# EAGLE board Resistor_Resistor (EAGLE 8.3.0), part 3 of 32
## Placement (x,y rotation side) (continued)
R2623  10K  [0201]  41.2,14.68 0 top
R2624  10K  [0201]  41.2,15.29 0 top
R2625  10K  [0201]  41.2,15.9 0 top
R2626  10K  [0201]  41.2,16.51 0 top
R2627  10K  [0201]  41.2,17.12 0 top
R2628  10K  [0201]  41.2,17.73 0 top
R2629  10K  [0201]  41.2,18.34 0 top
R2630  10K  [0201]  41.2,18.95 0 top
R2631  10K  [0201]  41.2,19.56 0 top
R2632  10K  [0201]  41.2,20.17 0 top
R2633  10K  [0201]  41.2,20.78 0 top
R2634  10K  [0201]  41.2,21.39 0 top
R2635  10K  [0201]  41.2,22 0 top
R2636  10K  [0201]  41.2,22.61 0 top
R2637  10K  [0201]  41.2,23.22 0 top
R2638  10K  [0201]  41.2,23.83 0 top
R2639  10K  [0201]  41.2,24.43 0 top
R2640  10K  [0201]  41.2,25.04 0 top
R2641  10K  [0201]  41.2,25.65 0 top
R2642  10K  [0201]  41.2,26.26 0 top
R2643  10K  [0201]  41.2,26.87 0 top
R2644  10K  [0201]  41.2,27.48 0 top
R2645  10K  [0201]  41.2,28.09 0 top
R2646  10K  [0201]  41.2,28.7 0 top
R2647  10K  [0201]  41.2,29.31 0 top
R2648  10K  [0201]  41.2,29.92 0 top
R2649  10K  [0201]  41.2,30.53 0 top
R2650  10K  [0201]  41.2,31.14 0 top
R2651  10K  [0201]  41.2,31.75 0 top
R2652  10K  [0201]  41.2,32.36 0 top
R2653  10K  [0201]  41.2,32.97 0 top
R2654  10K  [0201]  41.2,33.58 0 top
R2655  10K  [0201]  41.2,34.19 0 top
R2656  10K  [0201]  41.2,34.8 0 top
R2657  10K  [0201]  41.2,35.41 0 top
R2658  10K  [0201]  41.2,36.02 0 top
R2659  10K  [0201]  41.2,36.63 0 top
R2660  10K  [0201]  41.2,37.24 0 top
R2661  10K  [0201]  41.2,37.85 0 top
R2662  10K  [0201]  41.2,38.46 0 top
R2663  10K  [0201]  41.2,39.07 0 top
R2664  10K  [0201]  41.2,39.67 0 top
R2665  10K  [0201]  41.2,40.28 0 top
R2666  10K  [0201]  41.2,40.89 0 top
R2667  10K  [0201]  41.2,41.5 0 top
R2668  10K  [0201]  41.2,42.11 0 top
R2669  10K  [0201]  41.2,42.72 0 top
R2670  10K  [0201]  41.2,43.33 0 top
R2671  10K  [0201]  41.2,43.94 0 top
R2672  10K  [0201]  41.2,44.55 0 top
R2673  10K  [0201]  41.2,45.16 0 top
R2674  10K  [0201]  41.2,45.77 0 top
R2675  10K  [0201]  41.2,46.38 0 top
R2676  10K  [0201]  41.2,46.99 0 top
R2677  10K  [0201]  41.2,47.6 0 top
R2678  10K  [0201]  41.2,48.21 0 top
R2679  10K  [0201]  41.2,48.82 0 top
R2680  10K  [0201]  41.2,49.43 0 top
R2681  10K  [0201]  41.2,50.04 0 top
R2682  10K  [0201]  41.2,50.65 0 top
R2683  10K  [0201]  41.2,51.26 0 top
R2684  10K  [0201]  41.2,51.87 0 top
R2685  10K  [0201]  41.2,52.48 0 top
R2686  10K  [0201]  41.2,53.09 0 top
R2687  10K  [0201]  41.2,53.7 0 top
R2688  10K  [0201]  41.2,54.31 0 top
R2689  10K  [0201]  41.2,54.91 0 top
R2690  10K  [0201]  41.2,55.52 0 top
R2691  10K  [0201]  41.2,56.13 0 top
R2692  10K  [0201]  41.2,56.74 0 top
R2693  10K  [0201]  41.2,57.35 0 top
R2694  10K  [0201]  41.2,57.96 0 top
R2695  10K  [0201]  41.2,58.57 0 top
R2696  10K  [0201]  41.2,59.18 0 top
R2697  10K  [0201]  41.2,59.79 0 top
R2698  10K  [0201]  41.2,60.4 0 top
R2699  10K  [0201]  41.2,61.01 0 top
R2700  10K  [0201]  41.2,61.62 0 top
R2701  10K  [0201]  41.2,62.23 0 top
R2702  10K  [0201]  41.2,62.84 0 top
R2703  10K  [0201]  41.2,63.45 0 top
R2704  10K  [0201]  41.2,64.06 0 top
R2705  10K  [0201]  41.2,64.67 0 top
R2706  10K  [0201]  41.2,65.28 0 top
R2707  10K  [0201]  41.2,65.89 0 top
R2708  10K  [0201]  41.2,66.5 0 top
R2709  10K  [0201]  41.2,67.11 0 top
R2710  10K  [0201]  41.2,67.72 0 top
R2711  10K  [0201]  41.2,68.33 0 top
R2712  10K  [0201]  41.2,68.94 0 top
R2713  10K  [0201]  41.2,69.55 0 top
R2714  10K  [0201]  41.2,70.15 0 top
R2715  10K  [0201]  41.2,70.76 0 top
R2716  10K  [0201]  41.2,71.37 0 top
R2717  10K  [0201]  41.2,71.98 0 top
R2718  10K  [0201]  41.2,72.59 0 top
R2719  10K  [0201]  41.2,73.2 0 top
R2720  10K  [0201]  41.2,73.81 0 top
R2721  10K  [0201]  41.2,74.42 0 top
R2722  10K  [0201]  41.2,75.03 0 top
R2723  10K  [0201]  41.2,75.64 0 top
R2724  10K  [0201]  41.2,76.25 0 top
R2725  10K  [0201]  41.2,76.86 0 top
R2726  10K  [0201]  41.2,77.47 0 top
R2727  10K  [0201]  41.2,78.08 0 top
R2728  10K  [0201]  41.2,78.69 0 top
R2729  10K  [0201]  41.2,79.3 0 top
R2730  10K  [0201]  41.2,79.91 0 top
R2731  10K  [0201]  41.2,80.52 0 top
R2732  10K  [0201]  41.2,81.13 0 top
R2733  10K  [0201]  41.2,81.74 0 top
R2734  10K  [0201]  41.2,82.35 0 top
R2735  10K  [0201]  41.2,82.96 0 top
R2736  10K  [0201]  41.2,83.57 0 top
R2737  10K  [0201]  41.2,84.18 0 top
R2738  10K  [0201]  41.2,84.79 0 top
R2739  10K  [0201]  41.2,85.39 0 top
R2740  10K  [0201]  41.2,86 0 top
R2741  10K  [0201]  41.2,86.61 0 top
R2742  10K  [0201]  41.2,87.22 0 top
R2743  10K  [0201]  41.2,87.83 0 top
R2744  10K  [0201]  41.2,88.44 0 top
R2745  10K  [0201]  41.2,89.05 0 top
R2746  10K  [0201]  41.2,89.66 0 top
R2747  10K  [0201]  41.2,90.27 0 top
R2748  10K  [0201]  41.2,90.88 0 top
R2749  10K  [0201]  41.2,91.49 0 top
R2750  10K  [0201]  41.2,92.1 0 top
R2751  10K  [0201]  41.2,92.71 0 top
R2752  10K  [0201]  41.2,93.32 0 top
R2753  10K  [0201]  41.2,93.93 0 top
R2754  10K  [0201]  41.2,94.54 0 top
R2755  10K  [0201]  41.2,95.15 0 top
R2756  10K  [0201]  41.2,95.76 0 top
R2757  10K  [0201]  41.2,96.37 0 top
R2758  10K  [0201]  41.2,96.98 0 top
R2759  10K  [0201]  41.2,97.59 0 top
R2760  10K  [0201]  41.2,98.2 0 top
R2761  10K  [0201]  41.2,98.81 0 top
R2762  10K  [0201]  41.2,99.42 0 top
R2763  10K  [0201]  41.2,100.03 0 top
R2764  10K  [0201]  41.2,100.63 0 top
R2765  10K  [0201]  41.2,101.24 0 top
R2766  10K  [0201]  41.2,101.85 0 top
R2767  10K  [0201]  41.2,102.46 0 top
R2768  10K  [0201]  41.2,103.07 0 top
R2769  10K  [0201]  41.2,103.68 0 top
R2770  10K  [0201]  41.2,104.29 0 top
R2771  10K  [0201]  41.2,104.9 0 top
R2772  10K  [0201]  41.2,105.51 0 top
R2773  10K  [0201]  41.2,106.12 0 top
R2774  10K  [0201]  41.2,106.73 0 top
R2775  10K  [0201]  41.2,107.34 0 top
R2776  10K  [0201]  41.2,107.95 0 top
R2777  10K  [0201]  41.2,108.56 0 top
R2778  10K  [0201]  41.2,109.17 0 top
R2779  10K  [0201]  41.2,109.78 0 top
R2780  10K  [0201]  41.2,110.39 0 top
R2781  10K  [0201]  41.2,111 0 top
R2782  10K  [0201]  41.2,111.61 0 top
R2783  10K  [0201]  41.2,112.22 0 top
R2784  10K  [0201]  41.2,112.83 0 top
R2785  10K  [0201]  41.2,113.44 0 top
R2786  10K  [0201]  41.2,114.05 0 top
R2787  10K  [0201]  41.2,114.66 0 top
R2788  10K  [0201]  41.2,115.27 0 top
R2789  10K  [0201]  41.2,115.87 0 top
R2790  10K  [0201]  41.2,116.48 0 top
R2791  10K  [0201]  41.2,117.09 0 top
R2792  10K  [0201]  41.2,117.7 0 top
R2793  10K  [0201]  41.2,118.31 0 top
R2794  10K  [0201]  41.2,118.92 0 top
R2795  10K  [0201]  41.2,119.53 0 top
R2796  10K  [0201]  41.2,120.14 0 top
R2797  10K  [0201]  41.2,120.75 0 top
R2798  10K  [0201]  41.2,121.36 0 top
R2799  10K  [0201]  41.2,121.97 0 top
R2800  10K  [0201]  41.2,122.58 0 top
R2801  10K  [0201]  42.42,1.27 0 top
R2802  10K  [0201]  42.42,1.88 0 top
R2803  10K  [0201]  42.42,2.49 0 top
R2804  10K  [0201]  42.42,3.1 0 top
R2805  10K  [0201]  42.42,3.71 0 top
R2806  10K  [0201]  42.42,4.32 0 top
R2807  10K  [0201]  42.42,4.93 0 top
R2808  10K  [0201]  42.42,5.54 0 top
R2809  10K  [0201]  42.42,6.15 0 top
R2810  10K  [0201]  42.42,6.76 0 top
R2811  10K  [0201]  42.42,7.37 0 top
R2812  10K  [0201]  42.42,7.98 0 top
R2813  10K  [0201]  42.42,8.59 0 top
R2814  10K  [0201]  42.42,9.19 0 top
R2815  10K  [0201]  42.42,9.8 0 top
R2816  10K  [0201]  42.42,10.41 0 top
R2817  10K  [0201]  42.42,11.02 0 top
R2818  10K  [0201]  42.42,11.63 0 top
R2819  10K  [0201]  42.42,12.24 0 top
R2820  10K  [0201]  42.42,12.85 0 top
R2821  10K  [0201]  42.42,13.46 0 top
R2822  10K  [0201]  42.42,14.07 0 top
R2823  10K  [0201]  42.42,14.68 0 top
R2824  10K  [0201]  42.42,15.29 0 top
R2825  10K  [0201]  42.42,15.9 0 top
R2826  10K  [0201]  42.42,16.51 0 top
R2827  10K  [0201]  42.42,17.12 0 top
R2828  10K  [0201]  42.42,17.73 0 top
R2829  10K  [0201]  42.42,18.34 0 top
R2830  10K  [0201]  42.42,18.95 0 top
R2831  10K  [0201]  42.42,19.56 0 top
R2832  10K  [0201]  42.42,20.17 0 top
R2833  10K  [0201]  42.42,20.78 0 top
R2834  10K  [0201]  42.42,21.39 0 top
R2835  10K  [0201]  42.42,22 0 top
R2836  10K  [0201]  42.42,22.61 0 top
R2837  10K  [0201]  42.42,23.22 0 top
R2838  10K  [0201]  42.42,23.83 0 top
R2839  10K  [0201]  42.42,24.43 0 top
R2840  10K  [0201]  42.42,25.04 0 top
R2841  10K  [0201]  42.42,25.65 0 top
R2842  10K  [0201]  42.42,26.26 0 top
R2843  10K  [0201]  42.42,26.87 0 top
R2844  10K  [0201]  42.42,27.48 0 top
R2845  10K  [0201]  42.42,28.09 0 top
R2846  10K  [0201]  42.42,28.7 0 top
R2847  10K  [0201]  42.42,29.31 0 top
R2848  10K  [0201]  42.42,29.92 0 top
R2849  10K  [0201]  42.42,30.53 0 top
R2850  10K  [0201]  42.42,31.14 0 top
R2851  10K  [0201]  42.42,31.75 0 top
R2852  10K  [0201]  42.42,32.36 0 top
R2853  10K  [0201]  42.42,32.97 0 top
R2854  10K  [0201]  42.42,33.58 0 top
R2855  10K  [0201]  42.42,34.19 0 top
R2856  10K  [0201]  42.42,34.8 0 top
R2857  10K  [0201]  42.42,35.41 0 top
R2858  10K  [0201]  42.42,36.02 0 top
R2859  10K  [0201]  42.42,36.63 0 top
R2860  10K  [0201]  42.42,37.24 0 top
R2861  10K  [0201]  42.42,37.85 0 top
R2862  10K  [0201]  42.42,38.46 0 top
R2863  10K  [0201]  42.42,39.07 0 top
R2864  10K  [0201]  42.42,39.67 0 top
R2865  10K  [0201]  42.42,40.28 0 top
R2866  10K  [0201]  42.42,40.89 0 top
R2867  10K  [0201]  42.42,41.5 0 top
R2868  10K  [0201]  42.42,42.11 0 top
R2869  10K  [0201]  42.42,42.72 0 top
R2870  10K  [0201]  42.42,43.33 0 top
R2871  10K  [0201]  42.42,43.94 0 top
R2872  10K  [0201]  42.42,44.55 0 top
R2873  10K  [0201]  42.42,45.16 0 top
R2874  10K  [0201]  42.42,45.77 0 top
R2875  10K  [0201]  42.42,46.38 0 top
R2876  10K  [0201]  42.42,46.99 0 top
R2877  10K  [0201]  42.42,47.6 0 top
R2878  10K  [0201]  42.42,48.21 0 top
R2879  10K  [0201]  42.42,48.82 0 top
R2880  10K  [0201]  42.42,49.43 0 top
R2881  10K  [0201]  42.42,50.04 0 top
R2882  10K  [0201]  42.42,50.65 0 top
R2883  10K  [0201]  42.42,51.26 0 top
R2884  10K  [0201]  42.42,51.87 0 top
R2885  10K  [0201]  42.42,52.48 0 top
R2886  10K  [0201]  42.42,53.09 0 top
R2887  10K  [0201]  42.42,53.7 0 top
R2888  10K  [0201]  42.42,54.31 0 top
R2889  10K  [0201]  42.42,54.91 0 top
R2890  10K  [0201]  42.42,55.52 0 top
R2891  10K  [0201]  42.42,56.13 0 top
R2892  10K  [0201]  42.42,56.74 0 top
R2893  10K  [0201]  42.42,57.35 0 top
R2894  10K  [0201]  42.42,57.96 0 top
R2895  10K  [0201]  42.42,58.57 0 top
R2896  10K  [0201]  42.42,59.18 0 top
R2897  10K  [0201]  42.42,59.79 0 top
R2898  10K  [0201]  42.42,60.4 0 top
R2899  10K  [0201]  42.42,61.01 0 top
R2900  10K  [0201]  42.42,61.62 0 top
R2901  10K  [0201]  42.42,62.23 0 top
R2902  10K  [0201]  42.42,62.84 0 top
R2903  10K  [0201]  42.42,63.45 0 top
R2904  10K  [0201]  42.42,64.06 0 top
R2905  10K  [0201]  42.42,64.67 0 top
R2906  10K  [0201]  42.42,65.28 0 top
R2907  10K  [0201]  42.42,65.89 0 top
R2908  10K  [0201]  42.42,66.5 0 top
R2909  10K  [0201]  42.42,67.11 0 top
R2910  10K  [0201]  42.42,67.72 0 top
R2911  10K  [0201]  42.42,68.33 0 top
R2912  10K  [0201]  42.42,68.94 0 top
R2913  10K  [0201]  42.42,69.55 0 top
R2914  10K  [0201]  42.42,70.15 0 top
R2915  10K  [0201]  42.42,70.76 0 top
R2916  10K  [0201]  42.42,71.37 0 top
R2917  10K  [0201]  42.42,71.98 0 top
R2918  10K  [0201]  42.42,72.59 0 top
R2919  10K  [0201]  42.42,73.2 0 top
R2920  10K  [0201]  42.42,73.81 0 top
R2921  10K  [0201]  42.42,74.42 0 top
R2922  10K  [0201]  42.42,75.03 0 top
R2923  10K  [0201]  42.42,75.64 0 top
R2924  10K  [0201]  42.42,76.25 0 top
R2925  10K  [0201]  42.42,76.86 0 top
R2926  10K  [0201]  42.42,77.47 0 top
R2927  10K  [0201]  42.42,78.08 0 top
R2928  10K  [0201]  42.42,78.69 0 top
R2929  10K  [0201]  42.42,79.3 0 top
R2930  10K  [0201]  42.42,79.91 0 top
R2931  10K  [0201]  42.42,80.52 0 top
R2932  10K  [0201]  42.42,81.13 0 top
R2933  10K  [0201]  42.42,81.74 0 top
R2934  10K  [0201]  42.42,82.35 0 top
R2935  10K  [0201]  42.42,82.96 0 top
R2936  10K  [0201]  42.42,83.57 0 top
R2937  10K  [0201]  42.42,84.18 0 top
R2938  10K  [0201]  42.42,84.79 0 top
R2939  10K  [0201]  42.42,85.39 0 top
R2940  10K  [0201]  42.42,86 0 top
R2941  10K  [0201]  42.42,86.61 0 top
R2942  10K  [0201]  42.42,87.22 0 top
R2943  10K  [0201]  42.42,87.83 0 top
R2944  10K  [0201]  42.42,88.44 0 top
R2945  10K  [0201]  42.42,89.05 0 top
R2946  10K  [0201]  42.42,89.66 0 top
R2947  10K  [0201]  42.42,90.27 0 top
R2948  10K  [0201]  42.42,90.88 0 top
R2949  10K  [0201]  42.42,91.49 0 top
R2950  10K  [0201]  42.42,92.1 0 top
R2951  10K  [0201]  42.42,92.71 0 top
R2952  10K  [0201]  42.42,93.32 0 top
R2953  10K  [0201]  42.42,93.93 0 top
R2954  10K  [0201]  42.42,94.54 0 top
R2955  10K  [0201]  42.42,95.15 0 top
R2956  10K  [0201]  42.42,95.76 0 top
R2957  10K  [0201]  42.42,96.37 0 top
R2958  10K  [0201]  42.42,96.98 0 top
R2959  10K  [0201]  42.42,97.59 0 top
R2960  10K  [0201]  42.42,98.2 0 top
R2961  10K  [0201]  42.42,98.81 0 top
R2962  10K  [0201]  42.42,99.42 0 top
R2963  10K  [0201]  42.42,100.03 0 top
R2964  10K  [0201]  42.42,100.63 0 top
R2965  10K  [0201]  42.42,101.24 0 top
R2966  10K  [0201]  42.42,101.85 0 top
R2967  10K  [0201]  42.42,102.46 0 top
R2968  10K  [0201]  42.42,103.07 0 top
R2969  10K  [0201]  42.42,103.68 0 top
R2970  10K  [0201]  42.42,104.29 0 top
R2971  10K  [0201]  42.42,104.9 0 top
R2972  10K  [0201]  42.42,105.51 0 top
R2973  10K  [0201]  42.42,106.12 0 top
R2974  10K  [0201]  42.42,106.73 0 top
R2975  10K  [0201]  42.42,107.34 0 top
R2976  10K  [0201]  42.42,107.95 0 top
R2977  10K  [0201]  42.42,108.56 0 top
R2978  10K  [0201]  42.42,109.17 0 top
R2979  10K  [0201]  42.42,109.78 0 top
R2980  10K  [0201]  42.42,110.39 0 top
R2981  10K  [0201]  42.42,111 0 top
R2982  10K  [0201]  42.42,111.61 0 top
R2983  10K  [0201]  42.42,112.22 0 top
R2984  10K  [0201]  42.42,112.83 0 top
R2985  10K  [0201]  42.42,113.44 0 top
R2986  10K  [0201]  42.42,114.05 0 top
R2987  10K  [0201]  42.42,114.66 0 top
R2988  10K  [0201]  42.42,115.27 0 top
R2989  10K  [0201]  42.42,115.87 0 top
R2990  10K  [0201]  42.42,116.48 0 top
R2991  10K  [0201]  42.42,117.09 0 top
R2992  10K  [0201]  42.42,117.7 0 top
R2993  10K  [0201]  42.42,118.31 0 top
R2994  10K  [0201]  42.42,118.92 0 top
R2995  10K  [0201]  42.42,119.53 0 top
R2996  10K  [0201]  42.42,120.14 0 top
R2997  10K  [0201]  42.42,120.75 0 top
R2998  10K  [0201]  42.42,121.36 0 top
R2999  10K  [0201]  42.42,121.97 0 top
R3000  10K  [0201]  42.42,122.58 0 top
R3001  10K  [0201]  43.64,1.27 0 top
R3002  10K  [0201]  43.64,1.88 0 top
R3003  10K  [0201]  43.64,2.49 0 top
R3004  10K  [0201]  43.64,3.1 0 top
R3005  10K  [0201]  43.64,3.71 0 top
R3006  10K  [0201]  43.64,4.32 0 top
R3007  10K  [0201]  43.64,4.93 0 top
R3008  10K  [0201]  43.64,5.54 0 top
R3009  10K  [0201]  43.64,6.15 0 top
R3010  10K  [0201]  43.64,6.76 0 top
R3011  10K  [0201]  43.64,7.37 0 top
R3012  10K  [0201]  43.64,7.98 0 top
R3013  10K  [0201]  43.64,8.59 0 top
R3014  10K  [0201]  43.64,9.19 0 top
R3015  10K  [0201]  43.64,9.8 0 top
R3016  10K  [0201]  43.64,10.41 0 top
R3017  10K  [0201]  43.64,11.02 0 top
R3018  10K  [0201]  43.64,11.63 0 top
R3019  10K  [0201]  43.64,12.24 0 top
R3020  10K  [0201]  43.64,12.85 0 top
R3021  10K  [0201]  43.64,13.46 0 top
R3022  10K  [0201]  43.64,14.07 0 top
R3023  10K  [0201]  43.64,14.68 0 top
R3024  10K  [0201]  43.64,15.29 0 top
R3025  10K  [0201]  43.64,15.9 0 top
R3026  10K  [0201]  43.64,16.51 0 top
R3027  10K  [0201]  43.64,17.12 0 top
R3028  10K  [0201]  43.64,17.73 0 top
R3029  10K  [0201]  43.64,18.34 0 top
R3030  10K  [0201]  43.64,18.95 0 top
R3031  10K  [0201]  43.64,19.56 0 top
R3032  10K  [0201]  43.64,20.17 0 top
R3033  10K  [0201]  43.64,20.78 0 top
R3034  10K  [0201]  43.64,21.39 0 top
R3035  10K  [0201]  43.64,22 0 top
R3036  10K  [0201]  43.64,22.61 0 top
R3037  10K  [0201]  43.64,23.22 0 top
R3038  10K  [0201]  43.64,23.83 0 top
R3039  10K  [0201]  43.64,24.43 0 top
R3040  10K  [0201]  43.64,25.04 0 top
R3041  10K  [0201]  43.64,25.65 0 top
R3042  10K  [0201]  43.64,26.26 0 top
R3043  10K  [0201]  43.64,26.87 0 top
R3044  10K  [0201]  43.64,27.48 0 top
R3045  10K  [0201]  43.64,28.09 0 top
R3046  10K  [0201]  43.64,28.7 0 top
R3047  10K  [0201]  43.64,29.31 0 top
R3048  10K  [0201]  43.64,29.92 0 top
R3049  10K  [0201]  43.64,30.53 0 top
R3050  10K  [0201]  43.64,31.14 0 top
R3051  10K  [0201]  43.64,31.75 0 top
R3052  10K  [0201]  43.64,32.36 0 top
R3053  10K  [0201]  43.64,32.97 0 top
R3054  10K  [0201]  43.64,33.58 0 top
R3055  10K  [0201]  43.64,34.19 0 top
R3056  10K  [0201]  43.64,34.8 0 top
R3057  10K  [0201]  43.64,35.41 0 top
R3058  10K  [0201]  43.64,36.02 0 top
R3059  10K  [0201]  43.64,36.63 0 top
R3060  10K  [0201]  43.64,37.24 0 top
R3061  10K  [0201]  43.64,37.85 0 top
R3062  10K  [0201]  43.64,38.46 0 top
R3063  10K  [0201]  43.64,39.07 0 top
R3064  10K  [0201]  43.64,39.67 0 top
R3065  10K  [0201]  43.64,40.28 0 top
R3066  10K  [0201]  43.64,40.89 0 top
R3067  10K  [0201]  43.64,41.5 0 top
R3068  10K  [0201]  43.64,42.11 0 top
R3069  10K  [0201]  43.64,42.72 0 top
R3070  10K  [0201]  43.64,43.33 0 top
R3071  10K  [0201]  43.64,43.94 0 top
R3072  10K  [0201]  43.64,44.55 0 top
R3073  10K  [0201]  43.64,45.16 0 top
R3074  10K  [0201]  43.64,45.77 0 top
R3075  10K  [0201]  43.64,46.38 0 top
R3076  10K  [0201]  43.64,46.99 0 top
R3077  10K  [0201]  43.64,47.6 0 top
R3078  10K  [0201]  43.64,48.21 0 top
R3079  10K  [0201]  43.64,48.82 0 top
R3080  10K  [0201]  43.64,49.43 0 top
R3081  10K  [0201]  43.64,50.04 0 top
R3082  10K  [0201]  43.64,50.65 0 top
R3083  10K  [0201]  43.64,51.26 0 top
R3084  10K  [0201]  43.64,51.87 0 top
R3085  10K  [0201]  43.64,52.48 0 top
R3086  10K  [0201]  43.64,53.09 0 top
R3087  10K  [0201]  43.64,53.7 0 top
R3088  10K  [0201]  43.64,54.31 0 top
R3089  10K  [0201]  43.64,54.91 0 top
R3090  10K  [0201]  43.64,55.52 0 top
R3091  10K  [0201]  43.64,56.13 0 top
R3092  10K  [0201]  43.64,56.74 0 top
R3093  10K  [0201]  43.64,57.35 0 top
R3094  10K  [0201]  43.64,57.96 0 top
R3095  10K  [0201]  43.64,58.57 0 top
R3096  10K  [0201]  43.64,59.18 0 top
R3097  10K  [0201]  43.64,59.79 0 top
R3098  10K  [0201]  43.64,60.4 0 top
R3099  10K  [0201]  43.64,61.01 0 top
R3100  10K  [0201]  43.64,61.62 0 top
R3101  10K  [0201]  43.64,62.23 0 top
R3102  10K  [0201]  43.64,62.84 0 top
R3103  10K  [0201]  43.64,63.45 0 top
R3104  10K  [0201]  43.64,64.06 0 top
R3105  10K  [0201]  43.64,64.67 0 top
R3106  10K  [0201]  43.64,65.28 0 top
R3107  10K  [0201]  43.64,65.89 0 top
R3108  10K  [0201]  43.64,66.5 0 top
R3109  10K  [0201]  43.64,67.11 0 top
R3110  10K  [0201]  43.64,67.72 0 top
R3111  10K  [0201]  43.64,68.33 0 top
R3112  10K  [0201]  43.64,68.94 0 top
R3113  10K  [0201]  43.64,69.55 0 top
R3114  10K  [0201]  43.64,70.15 0 top
R3115  10K  [0201]  43.64,70.76 0 top
R3116  10K  [0201]  43.64,71.37 0 top
R3117  10K  [0201]  43.64,71.98 0 top
R3118  10K  [0201]  43.64,72.59 0 top
R3119  10K  [0201]  43.64,73.2 0 top
R3120  10K  [0201]  43.64,73.81 0 top
R3121  10K  [0201]  43.64,74.42 0 top
R3122  10K  [0201]  43.64,75.03 0 top
R3123  10K  [0201]  43.64,75.64 0 top
R3124  10K  [0201]  43.64,76.25 0 top
R3125  10K  [0201]  43.64,76.86 0 top
R3126  10K  [0201]  43.64,77.47 0 top
R3127  10K  [0201]  43.64,78.08 0 top
R3128  10K  [0201]  43.64,78.69 0 top
R3129  10K  [0201]  43.64,79.3 0 top
R3130  10K  [0201]  43.64,79.91 0 top
R3131  10K  [0201]  43.64,80.52 0 top
R3132  10K  [0201]  43.64,81.13 0 top
R3133  10K  [0201]  43.64,81.74 0 top
R3134  10K  [0201]  43.64,82.35 0 top
R3135  10K  [0201]  43.64,82.96 0 top
R3136  10K  [0201]  43.64,83.57 0 top
R3137  10K  [0201]  43.64,84.18 0 top
R3138  10K  [0201]  43.64,84.79 0 top
R3139  10K  [0201]  43.64,85.39 0 top
R3140  10K  [0201]  43.64,86 0 top
R3141  10K  [0201]  43.64,86.61 0 top
R3142  10K  [0201]  43.64,87.22 0 top
R3143  10K  [0201]  43.64,87.83 0 top
R3144  10K  [0201]  43.64,88.44 0 top
R3145  10K  [0201]  43.64,89.05 0 top
R3146  10K  [0201]  43.64,89.66 0 top
R3147  10K  [0201]  43.64,90.27 0 top
R3148  10K  [0201]  43.64,90.88 0 top
R3149  10K  [0201]  43.64,91.49 0 top
R3150  10K  [0201]  43.64,92.1 0 top
R3151  10K  [0201]  43.64,92.71 0 top
R3152  10K  [0201]  43.64,93.32 0 top
R3153  10K  [0201]  43.64,93.93 0 top
R3154  10K  [0201]  43.64,94.54 0 top
R3155  10K  [0201]  43.64,95.15 0 top
R3156  10K  [0201]  43.64,95.76 0 top
R3157  10K  [0201]  43.64,96.37 0 top
R3158  10K  [0201]  43.64,96.98 0 top
R3159  10K  [0201]  43.64,97.59 0 top
R3160  10K  [0201]  43.64,98.2 0 top
R3161  10K  [0201]  43.64,98.81 0 top
R3162  10K  [0201]  43.64,99.42 0 top
R3163  10K  [0201]  43.64,100.03 0 top
R3164  10K  [0201]  43.64,100.63 0 top
R3165  10K  [0201]  43.64,101.24 0 top
R3166  10K  [0201]  43.64,101.85 0 top
R3167  10K  [0201]  43.64,102.46 0 top
R3168  10K  [0201]  43.64,103.07 0 top
R3169  10K  [0201]  43.64,103.68 0 top
R3170  10K  [0201]  43.64,104.29 0 top
R3171  10K  [0201]  43.64,104.9 0 top
R3172  10K  [0201]  43.64,105.51 0 top
R3173  10K  [0201]  43.64,106.12 0 top
R3174  10K  [0201]  43.64,106.73 0 top
R3175  10K  [0201]  43.64,107.34 0 top
R3176  10K  [0201]  43.64,107.95 0 top
R3177  10K  [0201]  43.64,108.56 0 top
R3178  10K  [0201]  43.64,109.17 0 top
R3179  10K  [0201]  43.64,109.78 0 top
R3180  10K  [0201]  43.64,110.39 0 top
R3181  10K  [0201]  43.64,111 0 top
R3182  10K  [0201]  43.64,111.61 0 top
R3183  10K  [0201]  43.64,112.22 0 top
R3184  10K  [0201]  43.64,112.83 0 top
R3185  10K  [0201]  43.64,113.44 0 top
R3186  10K  [0201]  43.64,114.05 0 top
R3187  10K  [0201]  43.64,114.66 0 top
R3188  10K  [0201]  43.64,115.27 0 top
R3189  10K  [0201]  43.64,115.87 0 top
R3190  10K  [0201]  43.64,116.48 0 top
R3191  10K  [0201]  43.64,117.09 0 top
R3192  10K  [0201]  43.64,117.7 0 top
R3193  10K  [0201]  43.64,118.31 0 top
R3194  10K  [0201]  43.64,118.92 0 top
R3195  10K  [0201]  43.64,119.53 0 top
R3196  10K  [0201]  43.64,120.14 0 top
R3197  10K  [0201]  43.64,120.75 0 top
R3198  10K  [0201]  43.64,121.36 0 top
R3199  10K  [0201]  43.64,121.97 0 top
R3200  10K  [0201]  43.64,122.58 0 top
R3201  10K  [0201]  44.86,1.27 0 top
R3202  10K  [0201]  44.86,1.88 0 top
R3203  10K  [0201]  44.86,2.49 0 top
R3204  10K  [0201]  44.86,3.1 0 top
R3205  10K  [0201]  44.86,3.71 0 top
R3206  10K  [0201]  44.86,4.32 0 top
R3207  10K  [0201]  44.86,4.93 0 top
R3208  10K  [0201]  44.86,5.54 0 top
R3209  10K  [0201]  44.86,6.15 0 top
R3210  10K  [0201]  44.86,6.76 0 top
R3211  10K  [0201]  44.86,7.37 0 top
R3212  10K  [0201]  44.86,7.98 0 top
R3213  10K  [0201]  44.86,8.59 0 top
R3214  10K  [0201]  44.86,9.19 0 top
R3215  10K  [0201]  44.86,9.8 0 top
R3216  10K  [0201]  44.86,10.41 0 top
R3217  10K  [0201]  44.86,11.02 0 top
R3218  10K  [0201]  44.86,11.63 0 top
R3219  10K  [0201]  44.86,12.24 0 top
R3220  10K  [0201]  44.86,12.85 0 top
R3221  10K  [0201]  44.86,13.46 0 top
R3222  10K  [0201]  44.86,14.07 0 top
R3223  10K  [0201]  44.86,14.68 0 top
R3224  10K  [0201]  44.86,15.29 0 top
R3225  10K  [0201]  44.86,15.9 0 top
R3226  10K  [0201]  44.86,16.51 0 top
R3227  10K  [0201]  44.86,17.12 0 top
R3228  10K  [0201]  44.86,17.73 0 top
R3229  10K  [0201]  44.86,18.34 0 top
R3230  10K  [0201]  44.86,18.95 0 top
R3231  10K  [0201]  44.86,19.56 0 top
R3232  10K  [0201]  44.86,20.17 0 top
R3233  10K  [0201]  44.86,20.78 0 top
R3234  10K  [0201]  44.86,21.39 0 top
R3235  10K  [0201]  44.86,22 0 top
R3236  10K  [0201]  44.86,22.61 0 top
R3237  10K  [0201]  44.86,23.22 0 top
R3238  10K  [0201]  44.86,23.83 0 top
R3239  10K  [0201]  44.86,24.43 0 top
R3240  10K  [0201]  44.86,25.04 0 top
R3241  10K  [0201]  44.86,25.65 0 top
R3242  10K  [0201]  44.86,26.26 0 top
R3243  10K  [0201]  44.86,26.87 0 top
R3244  10K  [0201]  44.86,27.48 0 top
R3245  10K  [0201]  44.86,28.09 0 top
R3246  10K  [0201]  44.86,28.7 0 top
R3247  10K  [0201]  44.86,29.31 0 top
R3248  10K  [0201]  44.86,29.92 0 top
R3249  10K  [0201]  44.86,30.53 0 top
R3250  10K  [0201]  44.86,31.14 0 top
R3251  10K  [0201]  44.86,31.75 0 top
R3252  10K  [0201]  44.86,32.36 0 top
R3253  10K  [0201]  44.86,32.97 0 top
R3254  10K  [0201]  44.86,33.58 0 top
R3255  10K  [0201]  44.86,34.19 0 top
R3256  10K  [0201]  44.86,34.8 0 top
R3257  10K  [0201]  44.86,35.41 0 top
R3258  10K  [0201]  44.86,36.02 0 top
R3259  10K  [0201]  44.86,36.63 0 top
R3260  10K  [0201]  44.86,37.24 0 top
R3261  10K  [0201]  44.86,37.85 0 top
R3262  10K  [0201]  44.86,38.46 0 top
R3263  10K  [0201]  44.86,39.07 0 top
R3264  10K  [0201]  44.86,39.67 0 top
R3265  10K  [0201]  44.86,40.28 0 top
R3266  10K  [0201]  44.86,40.89 0 top
R3267  10K  [0201]  44.86,41.5 0 top
R3268  10K  [0201]  44.86,42.11 0 top
R3269  10K  [0201]  44.86,42.72 0 top
R3270  10K  [0201]  44.86,43.33 0 top
R3271  10K  [0201]  44.86,43.94 0 top
R3272  10K  [0201]  44.86,44.55 0 top
R3273  10K  [0201]  44.86,45.16 0 top
R3274  10K  [0201]  44.86,45.77 0 top
R3275  10K  [0201]  44.86,46.38 0 top
R3276  10K  [0201]  44.86,46.99 0 top
R3277  10K  [0201]  44.86,47.6 0 top
R3278  10K  [0201]  44.86,48.21 0 top
R3279  10K  [0201]  44.86,48.82 0 top
R3280  10K  [0201]  44.86,49.43 0 top